# EasyEDA Pro project 智能车.eprj, schematic 运放
Create Date: 2023-07-31; Page Name: P1; Project Name: 智能车; Schematic Name: 运放; Update Date: 2023-07-31; Company: 嘉立创EDA; Page Size: A4; Version: V1.0
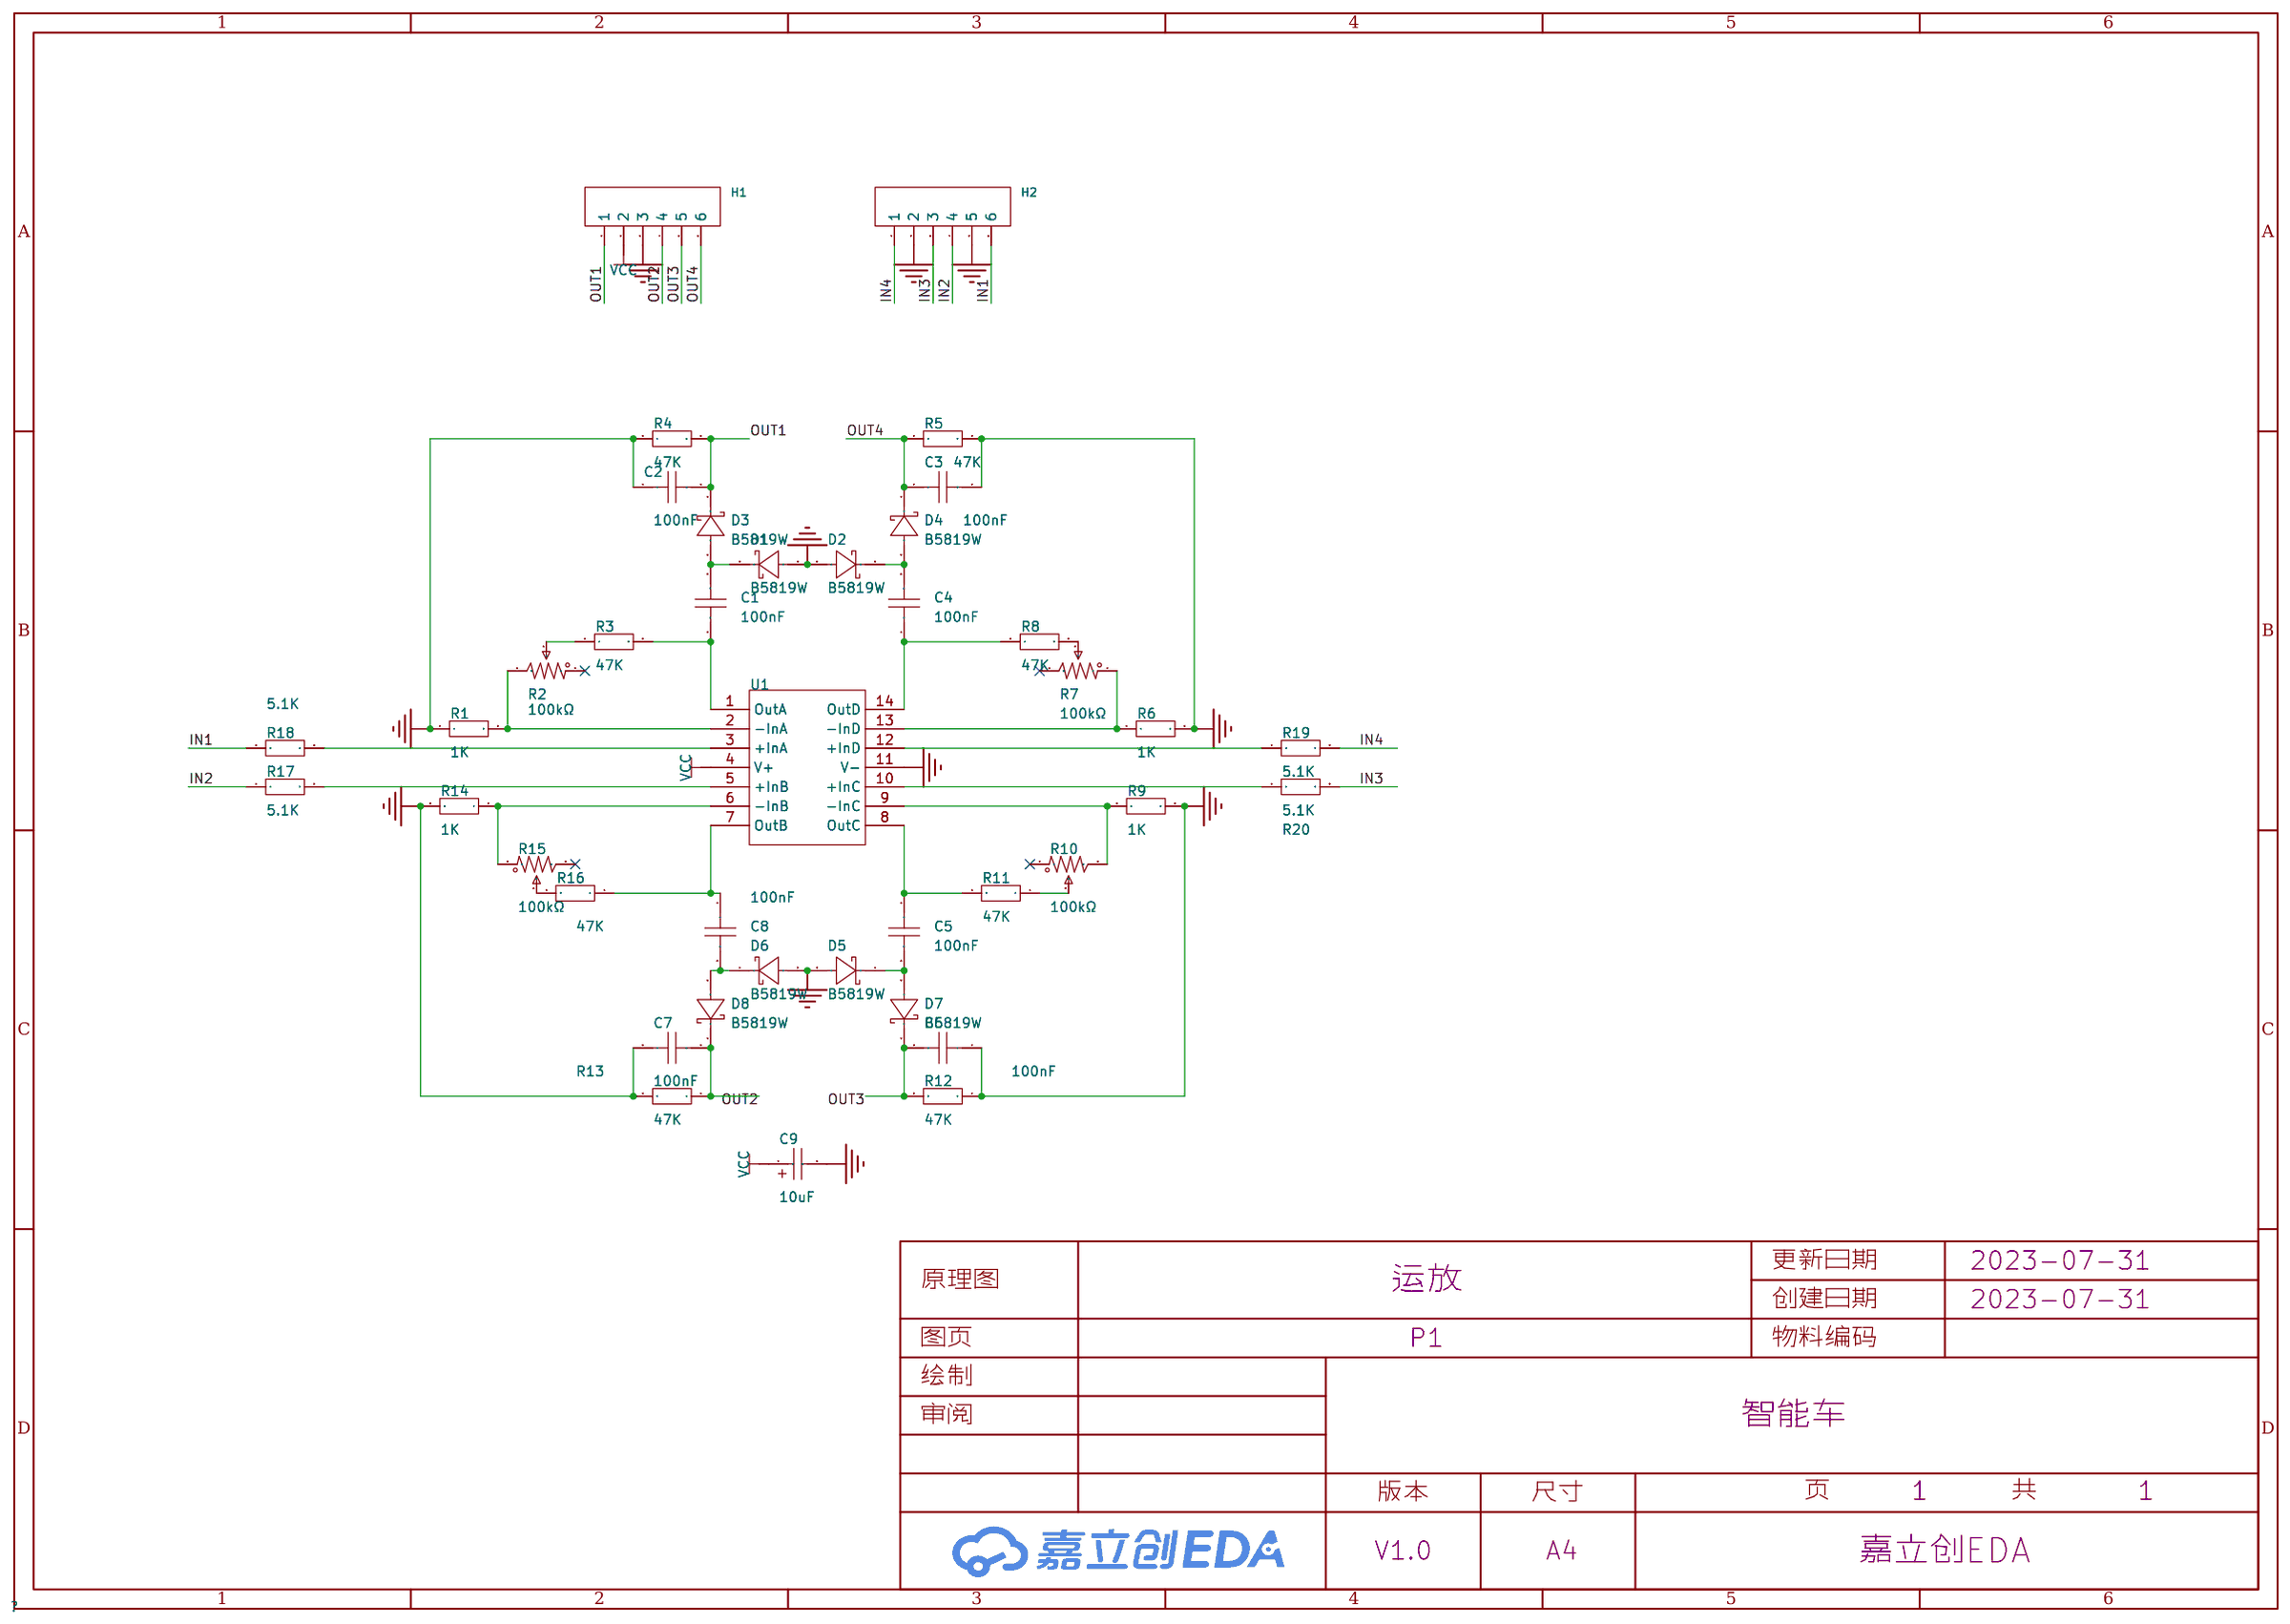
[diagram p0: schematic sheet]

## Parts
C1  100nF  [C0603]
C2  100nF  [C0603]
C3  100nF  [C0603]
C4  100nF  [C0603]
C5  100nF  [C0603]
C6  100nF  [C0603]
C7  100nF  [C0603]
C8  100nF  [C0603]
C9  10uF  [CAP-SMD_L3.2-W1.6-RD-C7171]
D1  B5819W  [SOD-123F_L2.7-W1.6-LS3.8-RD-1]
D2  B5819W  [SOD-123F_L2.7-W1.6-LS3.8-RD-1]
D3  B5819W  [SOD-123F_L2.7-W1.6-LS3.8-RD-1]
D4  B5819W  [SOD-123F_L2.7-W1.6-LS3.8-RD-1]
D5  B5819W  [SOD-123F_L2.7-W1.6-LS3.8-RD-1]
D6  B5819W  [SOD-123F_L2.7-W1.6-LS3.8-RD-1]
D7  B5819W  [SOD-123F_L2.7-W1.6-LS3.8-RD-1]
D8  B5819W  [SOD-123F_L2.7-W1.6-LS3.8-RD-1]
H1  -  [HDR-TH_6P-P2.54-V-M-1]
H2  -  [HDR-TH_6P-P2.54-V-M-1]
R1  1K  [R0603]
R2  100kΩ  [RES-ADJ-TH_3P-L10.0-W10.0-P2.50-L]
R3  47K  [R0603]
R4  47K  [R0603]
R5  47K  [R0603]
R6  1K  [R0603]
R7  100kΩ  [RES-ADJ-TH_3P-L10.0-W10.0-P2.50-L]
R8  47K  [R0603]
R9  1K  [R0603]
R10  100kΩ  [RES-ADJ-TH_3P-L10.0-W10.0-P2.50-L]
R11  47K  [R0603]
R12  47K  [R0603]
R13  47K  [R0603]
R14  1K  [R0603]
R15  100kΩ  [RES-ADJ-TH_3P-L10.0-W10.0-P2.50-L]
R16  47K  [R0603]
R17  5.1K  [R0603]
R18  5.1K  [R0603]
R19  5.1K  [R0603]
R20  5.1K  [R0603]
U1  -  [TSSOP-14_L4.9-W4.4-P0.65-LS6.4-BL]

## Library data of the parts
C1-C8 = CAP_0603: Supplier Footprint: 0603
C9 = TAJA106K016RNJ: 容值:10uF;精度:±10%;额定电压:16V;等效串联电阻:3Ω@100kHz;; LCSC Part Name: 10uF ±10% 16V; Supplier Part: C7171; Manufacturer: Kyocera AVX; Supplier Footprint: CASE-A-3216; JLCPCB Part Class: 基础库; Datasheet: https://atta.szlcsc.com/upload/public/pdf/source/20160107/1457707748093.pdf; Supplier: LCSC; Tolerance: ±10%; Rated Voltage: 16V; Equivalent Series Resistance(ESR): 3Ω@100kHz; Operating Temperature: -55℃~+125℃
D1-D8 = B5819W: 二极管配置:-;直流反向耐压(Vr):40V;平均整流电流(Io):1A;正向压降(Vf):580mV@1A;; LCSC Part Name: 40V 1A 580mV@1A; Supplier Part: C2943878; Manufacturer: GOODWORK(固得沃克); Supplier Footprint: SOD-123; JLCPCB Part Class: 扩展库; Datasheet: https://atta.szlcsc.com/upload/public/pdf/source/20220114/81042131F39C8520B6390246D7392C1A.pdf; Supplier: LCSC; Reverse Voltage (Vr): 40V; Average Rectified Current (Io): 1A; Forward Voltage (Vf@If): 580mV@1A; Reverse Leakage Current (Ir): 50uA@40V
H1 H2 = HDR-M_2.54_1x6P: Supplier Part: C37208; Supplier Footprint: 插件
R1 R3-R6 R8 R9 R11-R14 R16-R20 = Res_0603: Supplier Footprint: 0603
R2 R7 R10 R15 = 3296W-1-103: 阻值:10kΩ;精度:±10%;; LCSC Part Name: 10kΩ ±10%; Supplier Part: C118954; Manufacturer: BOCHEN(博晨); Supplier Footprint: 插件; JLCPCB Part Class: 扩展库; Datasheet: https://atta.szlcsc.com/upload/public/pdf/source/20171114/C118954_15106326646611117443.pdf; Supplier: LCSC; Tolerance: ±10%
U1 = OPA4377

## Nets
GND: C2.1 C3.2 C6.1 C7.2 C9.2 D1.2(A) D2.2(A) D5.2(A) D6.2(A) H1.3 H2.2 H2.5 R1.1 R4.1 R5.2 R6.2 R9.1 R12.1 R13.2 R14.2 U1.11(V-)
VCC: C9.1 H1.2 U1.4(V+)
IN1: H2.6 R18.1
IN2: H2.4 R17.1
IN3: H2.3 R20.2
IN4: H2.1 R19.2
OUT1: C2.2 D3.1(K) H1.1 R4.2
OUT2: C7.1 D8.1(K) H1.4 R13.1
OUT3: C6.2 D7.1(K) H1.5 R12.2
OUT4: C3.1 D4.1(K) H1.6 R5.1
$1N1313: R1.2 R2.3 U1.2(-InA)
$1N1314: R2.2 R3.1
$1N1315: C1.1 R3.2 U1.1(OutA)
$1N1316: C1.2 D1.1(K) D3.2(A)
$1N1318: C4.2 D2.1(K) D4.2(A)
$1N1320: R6.1 R7.1 U1.13(-InD)
$1N1321: R7.2 R8.2
$1N1322: C4.1 R8.1 U1.14(OutD)
$1N1328: R9.2 R10.3 U1.9(-InC)
$1N1329: R10.2 R11.1
$1N1330: C5.1 R11.2 U1.8(OutC)
$1N1331: C5.2 D5.1(K) D7.2(A)
$1N1333: C8.2 D6.1(K) D8.2(A)
$1N1335: R14.1 R15.1 U1.6(-InB)
$1N1336: R15.2 R16.2
$1N1337: C8.1 R16.1 U1.7(OutB)
$1N1342: R17.2 U1.5(+InB)
$1N1343: R18.2 U1.3(+InA)
$1N1344: R19.1 U1.12(+InD)
$1N1345: R20.1 U1.10(+InC)

Not connected (* = marked no-connect by the designer): R2 1*; R7 3*; R10 1*; R15 3*
